# EasyEDA Pro project MyWordEdit.eprj, board PCB1 (continued)
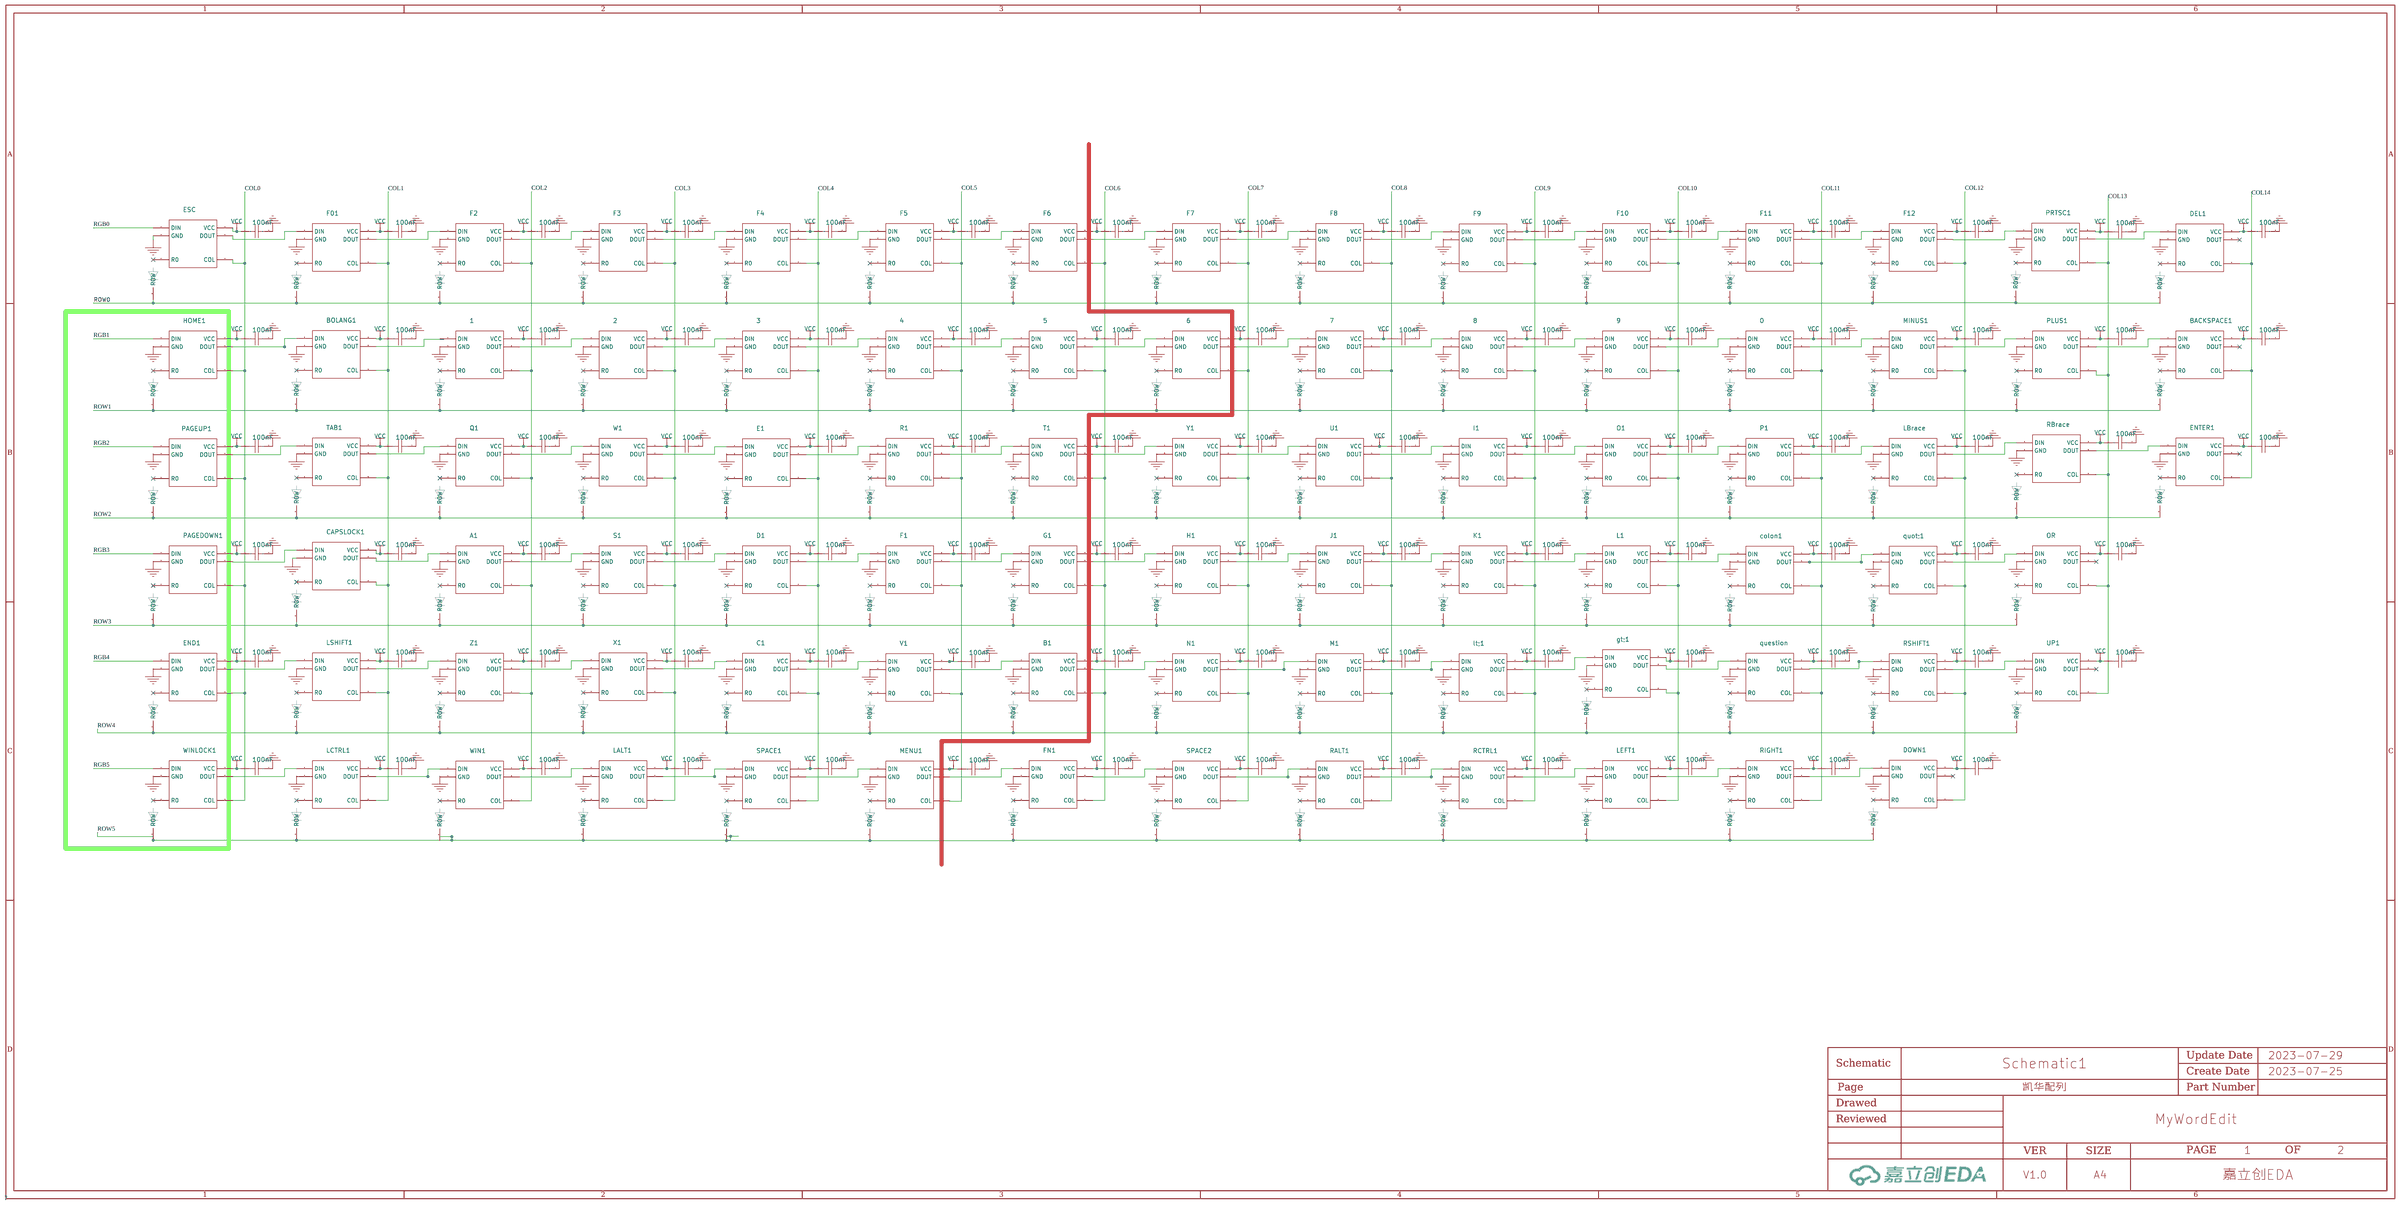
[diagram p0: 凯华配列]
## Routing (per net, layer and track width the routed paths; a pad name or vN(x,y) marks a point on that pad's centre or on a via; arc(x,y) is an arc through that point) (continued)
  Bottom Layer w0.254: C11.1 32.05,5.76 31.37,5.08 ; 146.3,19.81 145.38,20.73 C_MENU1.1 ; 146.3,19.81 150.5,19.81 v1(151.13,19.18) ; 146.3,19.81 145.92,19.43 143.89,19.43 142.93,18.47 MENU1.VCC 139.98,21.21 137.92,21.21 v1(136.65,22.48) ; v1(73.53,27.18) 85.33,27.18 C_LALT1.1 86.22,26.41 88.14,28.32 93.6,28.32 v1(95,26.92) ; C_06.1 147.19,96.77 v1(147.07,96.65) v1(145.16,98.55) ; X1.VCC 92.38,42.49 v1(91.31,43.56) ; v1(77.22,67.44) 79.5,65.15 v1(79.5,65.02) 91.3,65.02 C_S1.1 92.19,65.26 92.84,65.91 v1(95.5,65.91) ; v1(246.63,47.5) 238.38,47.5 v1(236.09,45.21) 235.59,45.72 v1(230.12,45.72) 231.47,44.37 C_LT;1.1 ; v1(181.36,70.1) 181.36,68.84 182.12,68.08 182.12,66.04 v1(182.63,65.53) ; 53.85,105.28 C_01.1 62.09,106.16 62.99,107.06 65.91,107.06 v1(66.68,106.3) ; 53.85,105.28 v1(51.31,102.74) ; 53.85,105.28 53.85,106.04 v1(52.96,106.93) ; 69.52,104.77 v1(68.2,104.77) ; 69.52,104.77 70.99,103.3 v1(70.99,103.25) ; 69.52,104.77 79.67,104.77 C_02.1 83.12,105.54 86.49,105.54 v1(87.12,104.9) ; v1(117.35,58.93) 117.88,58.39 122.48,58.39 ; 31.37,5.08 32.89,5.08 33.53,5.72 v1(33.53,7.75) ; 31.37,5.08 28.99,5.08 C12.1 ; F6.VCC 151.03,113.41 v1(149.35,113.41) ; 51.94,124.33 v1(53.47,122.81) ; 51.94,124.33 v1(50.8,124.33) ; 51.94,124.33 C_F01.1 63.22,125.32 63.5,125.6 67.95,125.6 v1(69.22,124.33) ; F12.VCC 270.64,121.15 270.64,121.92 v1(270,122.55) ; lt;1.VCC 223.24,42.29 v1(218.82,42.29) ; 101.73,120.38 103.26,121.92 108.46,121.92 v1(111.38,119) 111.89,119.51 120.26,119.51 C_F4.1 120.64,119.88 121.29,120.52 126.75,120.52 v1(129.92,117.35) 129.92,117.35 C_F5.1 139.28,117.95 139.95,118.62 145.8,118.62 v1(148.84,115.57) 160.27,115.57 161.94,113.9 C_F6.1 163.21,114.68 168.66,114.68 v1(170.56,112.78) 171.45,112.78 173.96,115.29 180.82,115.29 182.46,116.92 C_F7.1 182.84,117.94 183.52,118.62 189.61,118.62 v1(192.15,116.08) 194.57,118.5 C_F8.1 201.73,119.18 202.44,119.89 209.42,119.89 v1(210.95,118.36) 210.97,118.34 218.67,118.34 220.68,120.35 C_F9.1 222.03,121.67 228.22,121.67 v1(229.87,120.01) 230.63,120.78 237.99,120.78 C_F10.1 240.27,123.06 247.78,123.06 v1(249.17,121.67) 249.68,122.17 257.42,122.17 C_F11.1 258.56,123.94 259.21,124.59 266.7,124.59 v1(267.21,124.08) 276.34,124.08 C_F12.1 278.62,126.36 287.02,126.36 v1(288.04,125.35) 288.42,125.73 295.71,125.73 C_PRTSC1.1 296.66,127.62 297.43,128.4 306.2,128.4 308.48,126.12 ; 101.73,120.38 101.73,120.9 ; 101.73,120.38 101.84,120.27 92.53,120.27 v1(92.46,120.2) 90.99,121.67 v1(87,121.67) 87,123.19 86.77,123.41 C_F2.1 ; v1(77.09,45.97) 75.69,45.97 73.38,43.66 73.33,43.66 72.29,44.7 57.79,44.7 v1(55.88,46.61) ; v1(248.54,104.01) 248.67,104.01 v1(250.19,102.49) 251.95,104.24 C_MINUS1.1 262.01,105.79 v1(266.45,105.79) ; v1(173.23,112.78) 173.24,112.76 F7.VCC ; 9.14,115.44 3.56,109.85 3.56,94.98 ; 9.14,115.44 17.43,115.44 HOME1.VCC ; 9.14,115.44 14.61,120.9 v1(18.67,120.9) ; v1(178.82,96.65) 183.5,96.65 C_07.1 184.27,98.54 185.04,99.31 188.34,99.31 v1(188.47,99.19) ; 67.06,86.99 66.42,87.63 v1(66.42,88.14) ; 67.06,86.99 69.05,85 C_Q1.1 ; 67.06,86.99 74.82,86.99 v1(76.03,85.78) 82.74,85.78 v1(82.8,85.85) ; 315.46,128.02 310.37,128.02 308.48,126.12 ; v1(250.06,119.51) 250.2,119.37 251.58,119.37 ; 3.56,27.46 3.56,37.92 ; 3.56,27.46 3.56,25.65 19.43,9.78 v1(33.53,9.78) 45.18,9.78 47.13,7.83 U4.5 ; 3.56,27.46 6.25,24.76 17.65,24.76 21.21,28.32 v1(25.02,28.32) ; 3.56,37.92 5.11,39.47 WINLOCK1.VCC 10.98,40.69 11.81,41.53 C_WINLOCK.1 ; 3.56,37.92 3.56,56.01 ; C_O1.1 232.29,83.44 231.9,83.44 ; v1(230.76,61.34) 231.79,60.31 232.78,60.31 ; 269.46,105.69 C_PLUS1.1 279.16,106.82 279.78,107.44 v1(285.24,107.44) ; 269.46,105.69 268.76,105.69 v1(268.73,105.66) ; 269.46,105.69 269.88,105.28 v1(269.88,102.87) ; 39.75,86.87 38.79,85.91 TAB1.VCC 38.56,84.58 v1(34.16,84.58) ; 39.75,86.87 v1(40.39,87.5) ; 39.75,86.87 46.22,86.87 C_TAB.1 ; C_M1.1 211.71,43.93 v1(211.71,43.94) v1(217.17,43.94) 226.19,43.94 v1(227.97,45.72) ; v1(131.57,62.61) 130.3,62.61 129.78,62.09 C_F1.1 129.15,61.59 v1(117.35,61.59) v1(115.06,63.88) ; v1(211.84,116.08) 213.59,116.08 F9.VCC ; 231.9,83.44 v1(231.39,83.44) ; 231.9,83.44 233.43,84.96 237.36,84.96 v1(238.25,84.07) 238.89,84.71 v1(246.63,84.71) ; v1(54.74,121.41) 54.84,121.51 F01.VCC ; LALT1.VCC 78.64,24.13 74.55,24.13 v1(73.53,25.15) ; v1(24.51,62.61) 21.96,62.61 C_END.1 13.46,61.09 12.63,60.25 END1.VCC 5.94,58.39 3.56,56.01 ; question.VCC 257.06,43.8 v1(256.67,44.2) ; 308.48,126.12 308.48,124.32 ; v1(97.28,65.4) 98.55,64.13 v1(98.55,62.86) 99.31,63.63 109.51,63.63 C_D1.1 110.86,63.87 111.51,64.52 v1(112.52,64.52) ; v1(90.42,98.42) 91.9,98.42 3.VCC ; v1(247.02,62.74) 247.79,61.96 colon1.VCC ; v1(54.99,85.85) 54.99,85.72 57.94,82.78 62.54,82.78 ; v1(96.9,82.68) 100.13,79.45 E1.VCC ; v1(241.55,25.65) v1(223.77,25.65) 218.82,25.65 217.55,24.39 C_SPACE2.1 216.56,23.08 216.17,23.47 208.81,23.47 v1(208.41,23.88) ; v1(145.67,38.86) 147.6,36.93 149.28,36.93 ; v1(70.23,27.69) 67.95,29.97 61.6,29.97 60.21,28.58 ; v1(50.7,68.45) 49.43,69.72 48.26,69.72 47.03,68.5 C_CAPSLOCK.1 45.83,68.71 34.04,68.71 v1(31.62,66.29) v1(34.42,66.29) ; D1.VCC 99.6,60.04 v1(98.93,60.71) ; v1(60.07,28.45) 60.21,28.58 ; 60.21,28.58 C_WIN1.1 ; v1(188.47,53.34) 191.01,53.34 193.56,55.89 193.56,57.01 ; v1(157.86,19.18) v1(153.8,19.18) ; v1(188.21,18.16) 203.2,18.16 204.72,19.69 209.68,19.69 SPACE2.VCC 208.93,20.05 v1(207.39,21.59) ; 32,30.23 31.42,29.65 LCTRL1.VCC 31.14,28.32 v1(26.54,28.32) ; 32,30.23 33.27,31.5 v1(33.27,44.96) ; 32,30.23 40.55,30.23 41.65,29.13 ; 79.71,47.12 82.95,47.12 84.98,45.08 v1(89.03,45.08) v1(96.14,45.08) ; 79.71,47.12 C_Z1.1 ; 79.71,47.12 79.38,46.78 v1(79.38,46.74) ; v1(204.72,40.51) 205.99,39.25 M1.VCC ; v1(316.74,31.11) 316.73,31.11 DOWN1.VCC 316.72,29.46 312.67,29.46 309.63,32.51 306.01,32.51 C_RIGHT1.1 303.56,31.46 303.04,31.98 300,31.98 v1(299.47,32.51) ; 138.49,76.05 134.41,76.05 v1(132.46,78) ; C_BACKSPACE.1 302.26,108.08 300.6,106.42 BACKSPACE1.VCC 297.92,107.19 v1(288.29,107.19) ; v1(264.03,67.18) v1(268.61,67.18) C_QUOT;1.1 277.87,68.82 278.13,69.09 v1(279.91,69.09) ; v1(124.97,102.23) 120.27,102.23 118.99,100.95 C_04.1 116.55,102.51 108.61,102.51 v1(108.08,101.98) 109.98,100.08 v1(109.98,99.95) ; v1(259.59,82.17) 259.59,82.26 256.12,85.72 ; v1(277.5,84.84) 277.5,86.23 v1(275.97,87.76) 288.77,87.76 C_RBRACE.1 ; v1(299.94,50.04) 298.79,51.18 297.67,51.18 C_RSHIFT1.1 295.48,50.42 289.69,50.42 288.29,49.02 v1(278.13,49.02) 268.21,49.02 ; 210.85,100.68 C_09.1 223.39,101.85 v1(227.84,101.85) ; 210.85,100.68 212.22,99.31 v1(212.22,97.15) ; 210.85,100.68 v1(210.82,100.71) ; 136.59,42.04 C_V1.1 ; 136.59,42.04 140.34,42.04 v1(141.1,41.27) 142.57,39.8 151.56,39.8 v1(152.02,40.26) ; 136.59,42.04 136.21,41.66 v1(136.14,41.66) ; C_I1.1 213.02,80.86 211.07,82.8 v1(211.07,83.44) 217.81,83.44 v1(218.82,82.42) 219.84,83.44 v1(228.85,83.44) ; 41.65,29.13 41.72,29.21 47.37,29.21 v1(48.39,28.19) ; 41.65,29.13 C_LCTRL.1 ; 184.28,39.62 186.7,37.2 187.06,37.2 ; 184.28,39.62 v1(188.98,39.62) ; 184.28,39.62 184.1,39.8 178.03,39.8 177.59,39.37 163.47,39.37 163.04,39.8 160.1,39.8 158.62,41.27 154.68,41.27 ; v1(263.91,49.02) 258.83,49.02 v1(256.03,46.23) 254.76,47.5 v1(249.05,47.5) 250.86,45.68 C_GT;1.1 ; v1(209.3,42.67) v1(203.58,42.67) 193.29,42.67 v1(191.26,40.64) ; 268.21,49.02 C_QUESTION.1 ; 268.21,49.02 v1(267.72,49.02) ; 137.6,98.41 138.89,99.69 v1(143.51,99.69) ; 137.6,98.41 C_05.1 ; 137.6,98.41 137.2,98.81 v1(128.4,98.81) v1(126.87,100.33) ; 193.64,81.41 200.28,81.41 v1(201.04,80.64) 208.28,80.64 v1(209.8,82.17) ; 193.64,81.41 v1(193.04,81.41) 190.12,84.33 v1(190.12,91.49) ; 193.64,81.41 C_U1.1 ; K1.VCC 208.68,58.66 v1(208.41,58.93) ; v1(206.88,60.58) 205.74,61.72 205.74,61.96 ; SPACE1.VCC 112.07,22.28 113.28,23.5 v1(115.57,23.5) 115.63,23.43 C_SPACE1.1 ; F8.VCC 194.32,114.17 v1(192.79,114.17) ; v1(53.09,101.98) 53.14,102.03 54.11,102.03 1.VCC ; v1(192.66,57.91) 193.56,57.01 ; 193.56,57.01 J1.VCC ; v1(237.87,43.43) 237.87,43.31 239.03,42.15 243.96,42.15 ; v1(28.32,81.28) 29.21,81.28 v1(32.51,84.58) ; 169.29,74.29 169.04,74.55 v1(169.04,75.44) ; v1(232.03,118.74) 232.53,118.24 F10.VCC ; v1(219.84,80.64) 219.84,80.63 221.62,78.85 O1.VCC ; v1(30.23,64.9) 27.94,62.61 v1(26.67,62.61) ; 113.34,116.56 112.17,116.56 v1(111.76,116.97) ; v1(51.31,108.46) 44.83,108.46 43.4,107.03 C_BOLANG.1 42.77,107.44 v1(39.37,107.44) ; v1(191.26,40.64) 188.47,43.43 v1(188.47,51.18) ; v1(191.26,40.64) 193.92,40.64 C_N1.1 ; v1(242.94,65.28) 240.16,65.28 239.89,65.01 C_L1.1 239.26,63.25 v1(228.85,63.25) v1(226.06,63.25) ; v1(135.38,58.55) 135.38,60.71 v1(134.11,61.98) ; v1(213.49,95.88) 214.13,95.88 9.VCC ; PRTSC1.VCC 290.07,123.18 290.07,123.82 v1(289.81,124.08) ; v1(169.04,77.22) 169.47,77.64 C_Y1.1 177.34,78.87 v1(181.23,78.87) 191.64,78.87 v1(192.41,79.63) ; 58.4,66.19 56.13,68.45 v1(52.45,68.45) ; 58.4,66.19 72.48,66.19 C_A1.1 72.89,67.43 73.03,67.56 v1(74.55,67.56) ; 58.4,66.19 v1(58.42,66.17) ; LBrace.VCC 264.29,82.17 v1(262.38,82.17) ; v1(78.61,84.2) 81.46,81.35 81.46,81.13 ; 205.74,61.96 205.74,61.98 v1(200.41,61.98) 201.58,60.8 C_J1.1 ; 205.74,61.96 205.76,61.98 220.49,61.98 C_K1.1 220.97,63.23 221.23,63.5 v1(224.16,63.5) ; 4.VCC 110.52,97.51 v1(109.98,98.04) ; 8.VCC 194.42,95.36 v1(192.79,93.73) ; OR.VCC 287,68.07 283.85,68.07 v1(282.83,69.09) 296.74,69.09 C_OR.1 296.79,70.47 v1(297.31,70.99) ; 117.76,43.81 117.76,43.72 v1(117.35,43.31) 117.35,43.41 117.76,43.81 ; 117.76,43.81 C_C1.1 ; 117.76,43.81 121,43.81 123.29,41.53 v1(126.62,41.53) v1(133.22,41.53) ; V1.VCC 129.95,38.58 v1(128.27,40.26) ; v1(143,80.26) 143,80.14 144.91,78.23 145.4,78.23 C_T1.1 ; v1(34.54,46.23) 42.57,46.23 LSHIFT1.VCC 42.6,46.66 44.45,48.51 C_LSHIFT.1 50.03,47.76 v1(51.18,46.61) ; 73.72,100.81 72.04,100.81 v1(71.5,101.35) ; S1.VCC 80.16,61.69 v1(79.5,62.36) ; v1(114.68,43.31) v1(109.73,43.31) 104.37,43.31 102.39,45.28 99.15,45.28 ; ENTER1.VCC 308.87,75.31 v1(306.32,75.31) ; 105.28,84.33 111,84.33 v1(112.78,82.55) v1(124.21,82.55) ; 105.28,84.33 105.03,84.07 105.03,83.65 106.99,81.69 C_E1.1 ; 105.28,84.33 v1(105.03,84.33) ; v1(181.86,64.52) 184.4,61.98 v1(184.4,60.2) 182.87,60.2 ; v1(20.19,122.55) 21.23,123.59 C_HOME.1 C_ESC1.1 28.72,123.32 v1(30.86,123.32) ; v1(102.87,84.33) 102.82,84.38 v1(95.25,84.38) 93.78,85.85 v1(85.98,85.85) 85.98,85.22 87.76,83.44 88.64,83.44 ; 99.15,45.28 C_X1.1 ; 99.15,45.28 98.95,45.08 v1(98.68,45.08) ; CAPSLOCK1.VCC 36.98,65.63 v1(36.32,66.29) ; 3.56,94.98 4.94,96.37 15.93,96.37 15.93,97.21 17.65,98.93 C_PAGEUP.1 27.81,103.52 v1(27.81,103.76) ; 3.56,94.98 3.56,75.81 ; v1(231.14,100.33) 229.87,101.6 v1(229.87,101.73) 240.47,101.73 C_00.1 242.76,104.01 v1(246.13,104.01) ; v1(32,103.63) 32.31,103.94 35.44,103.94 BOLANG1.VCC ; RCTRL1.VCC 259.82,24.51 254.76,24.51 v1(253.37,25.91) ; v1(130.68,114.17) 131.53,114.17 F5.VCC ; 141.53,56.74 141.38,56.9 v1(138.94,56.9) 138.94,57.41 140.61,59.08 144.42,59.08 145.37,60.02 146.74,60.02 147.07,59.69 147.61,59.69 147.86,59.44 C_G1.1 ; v1(238.76,82.04) 238.76,82.03 240.28,80.5 P1.VCC ; 54.64,26.54 54.64,26.57 56.13,28.07 v1(58.42,28.07) ; 54.64,26.54 WIN1.VCC ; 54.64,26.54 v1(50.04,26.54) ; 256.12,85.72 249.54,85.72 v1(248.6,84.79) 251.88,84.79 C_P1.1 ; 256.12,85.72 270.93,85.72 C_LBRACE.1 272.96,87.76 v1(273.42,87.76) ; 3.56,56.01 3.56,75.81 ; 3.56,75.81 5.06,77.32 14.28,77.32 14.28,78.03 16,79.76 C_PAGEDOWN.1 21.71,80.89 22.1,81.28 v1(24.81,81.28) ; v1(59.56,63.75) 59.97,63.35 65.59,63.35 ; v1(136.78,56.9) 135.54,56.9 v1(135.38,57.06) ; v1(92.71,118.49) 92.99,118.21 94.29,118.21 ; v1(297.82,29.84) 297.81,29.84 297.81,27.8 297.67,27.94 287.94,27.94 C_LEFT1.1 285.65,30.23 v1(278.77,30.23) ; 207.38,77.2 202.96,77.2 v1(201.93,78.23) ; v1(278.13,27.56) 278.13,26.9 LEFT1.VCC 278.14,25.4 269.55,25.4 C_RCTRL1.1 265.86,29.08 v1(256.67,29.08) ; v1(181.99,77.09) 181.99,72.39 ; 181.99,72.39 185.15,75.55 U1.VCC ; 181.99,72.39 v1(181.99,72.26) ; v1(190.12,97.54) 191.72,99.14 C_08.1 204.87,100.71 v1(208.28,100.71) ; v1(301.75,71.5) 304.18,73.93 v1(304.18,75.31) 300.79,75.31 C_ENTER1.1 ; F2.VCC 73.69,119.86 v1(73.66,119.89) ; v1(106.3,103.76) 101.09,103.76 100.32,102.99 100.32,101.57 98.77,103.12 v1(88.9,103.12) 88.9,99.82 v1(89.03,99.69) ; 154.68,41.27 v1(154.31,41.27) ; 154.68,41.27 C_B1.1 ; v1(148.59,95.12) 148.62,95.12 6.VCC ; v1(68.71,122.43) 70.87,122.43 v1(72.14,121.16) 72.24,121.26 84.15,121.26 v1(84.56,121.67) ; RBrace.VCC 282.07,82.68 v1(279.65,82.68) ; v1(129.41,97.03) 129.44,97.03 130.61,95.86 ; v1(125.6,25.02) 135.26,25.02 v1(135.89,24.38) ; v1(270.64,101.09) 271.15,101.09 PLUS1.VCC ; C_R1.1 125.93,80.19 125.7,80.42 125.7,82.14 v1(126.11,82.55) 130.3,82.55 132.46,80.39 v1(132.46,80.26) v1(141.01,80.26) ; 182.87,60.2 182.69,60.02 180.99,60.02 180.59,59.62 180.59,58.29 179.83,57.53 179.58,57.53 178.94,56.9 178.94,56.77 177.93,56.77 177.8,56.64 176.53,56.64 175.89,56 175.89,55.36 ; 182.87,60.2 C_H1.1 ; v1(261.93,67.18) 259.72,67.18 258.99,66.45 C_COLON1.1 258.63,65.28 v1(244.48,65.28) v1(245.62,64.13) ; v1(35.31,123.32) 37.24,123.32 ESC.VCC 37.39,123.63 38.1,124.33 47.88,124.33 v1(48.77,123.44) ; v1(36.45,107.44) 32.89,107.44 v1(30.1,104.65) ; MINUS1.VCC 252.99,100.08 v1(251.33,100.08) ; v1(111.25,41.66) 111.43,41.47 C1.VCC ; v1(113.92,80.01) 116.23,77.7 119.44,77.7 ; 0.VCC 232.81,98.66 v1(232.54,98.93) ; C_UP1.1 317.5,51.94 315.08,49.52 315.08,48.37 303.8,48.37 v1(302.13,50.04) ; 7.VCC 176.91,94.08 v1(176.91,94.87) ; v1(243.08,26.92) 243.37,26.64 247.72,26.64 C_RALT1.1 247.98,26.62 249.68,28.32 251.71,28.32 v1(252.35,27.69) v1(254.64,27.69) ; v1(225.55,23.75) 240.01,23.75 240.91,22.85 ; v1(42.16,89.15) v1(48.01,89.15) ; v1(187.07,19.3) 186.43,19.95 C_FN1.1 186.21,20.83 181.23,20.83 179.19,18.79 FN1.VCC 178.06,16.26 168.91,16.26 165.99,19.18 v1(161.04,19.18) ; v1(279.15,46.48) 279.78,45.85 288.81,45.85 RSHIFT1.VCC ; v1(188.34,60.2) v1(193.55,60.2) v1(197.87,60.2) ; v1(317.37,33.02) C_DOWN1.1 ; v1(122.81,25.78) v1(113.28,25.78) 98.3,25.78 v1(97.54,26.54) ; v1(51.82,89.15) 53.47,89.15 v1(54.48,88.14) v1(63.88,88.14) ; quot;1.VCC 270.02,63.61 v1(268.61,65.02)
